# EasyEDA Pro project DartCharger.eprj, schematic DartCharger

## Sheets
1 Power: Create Date: 2024-04-09; Page Name: Power; Project Name: DartCharger; Schematic Name: DartCharger; Update Date: 2024-04-21; Company: 3SE战队; Drawed: 程浩; Page Size: A4; Version: V1.0
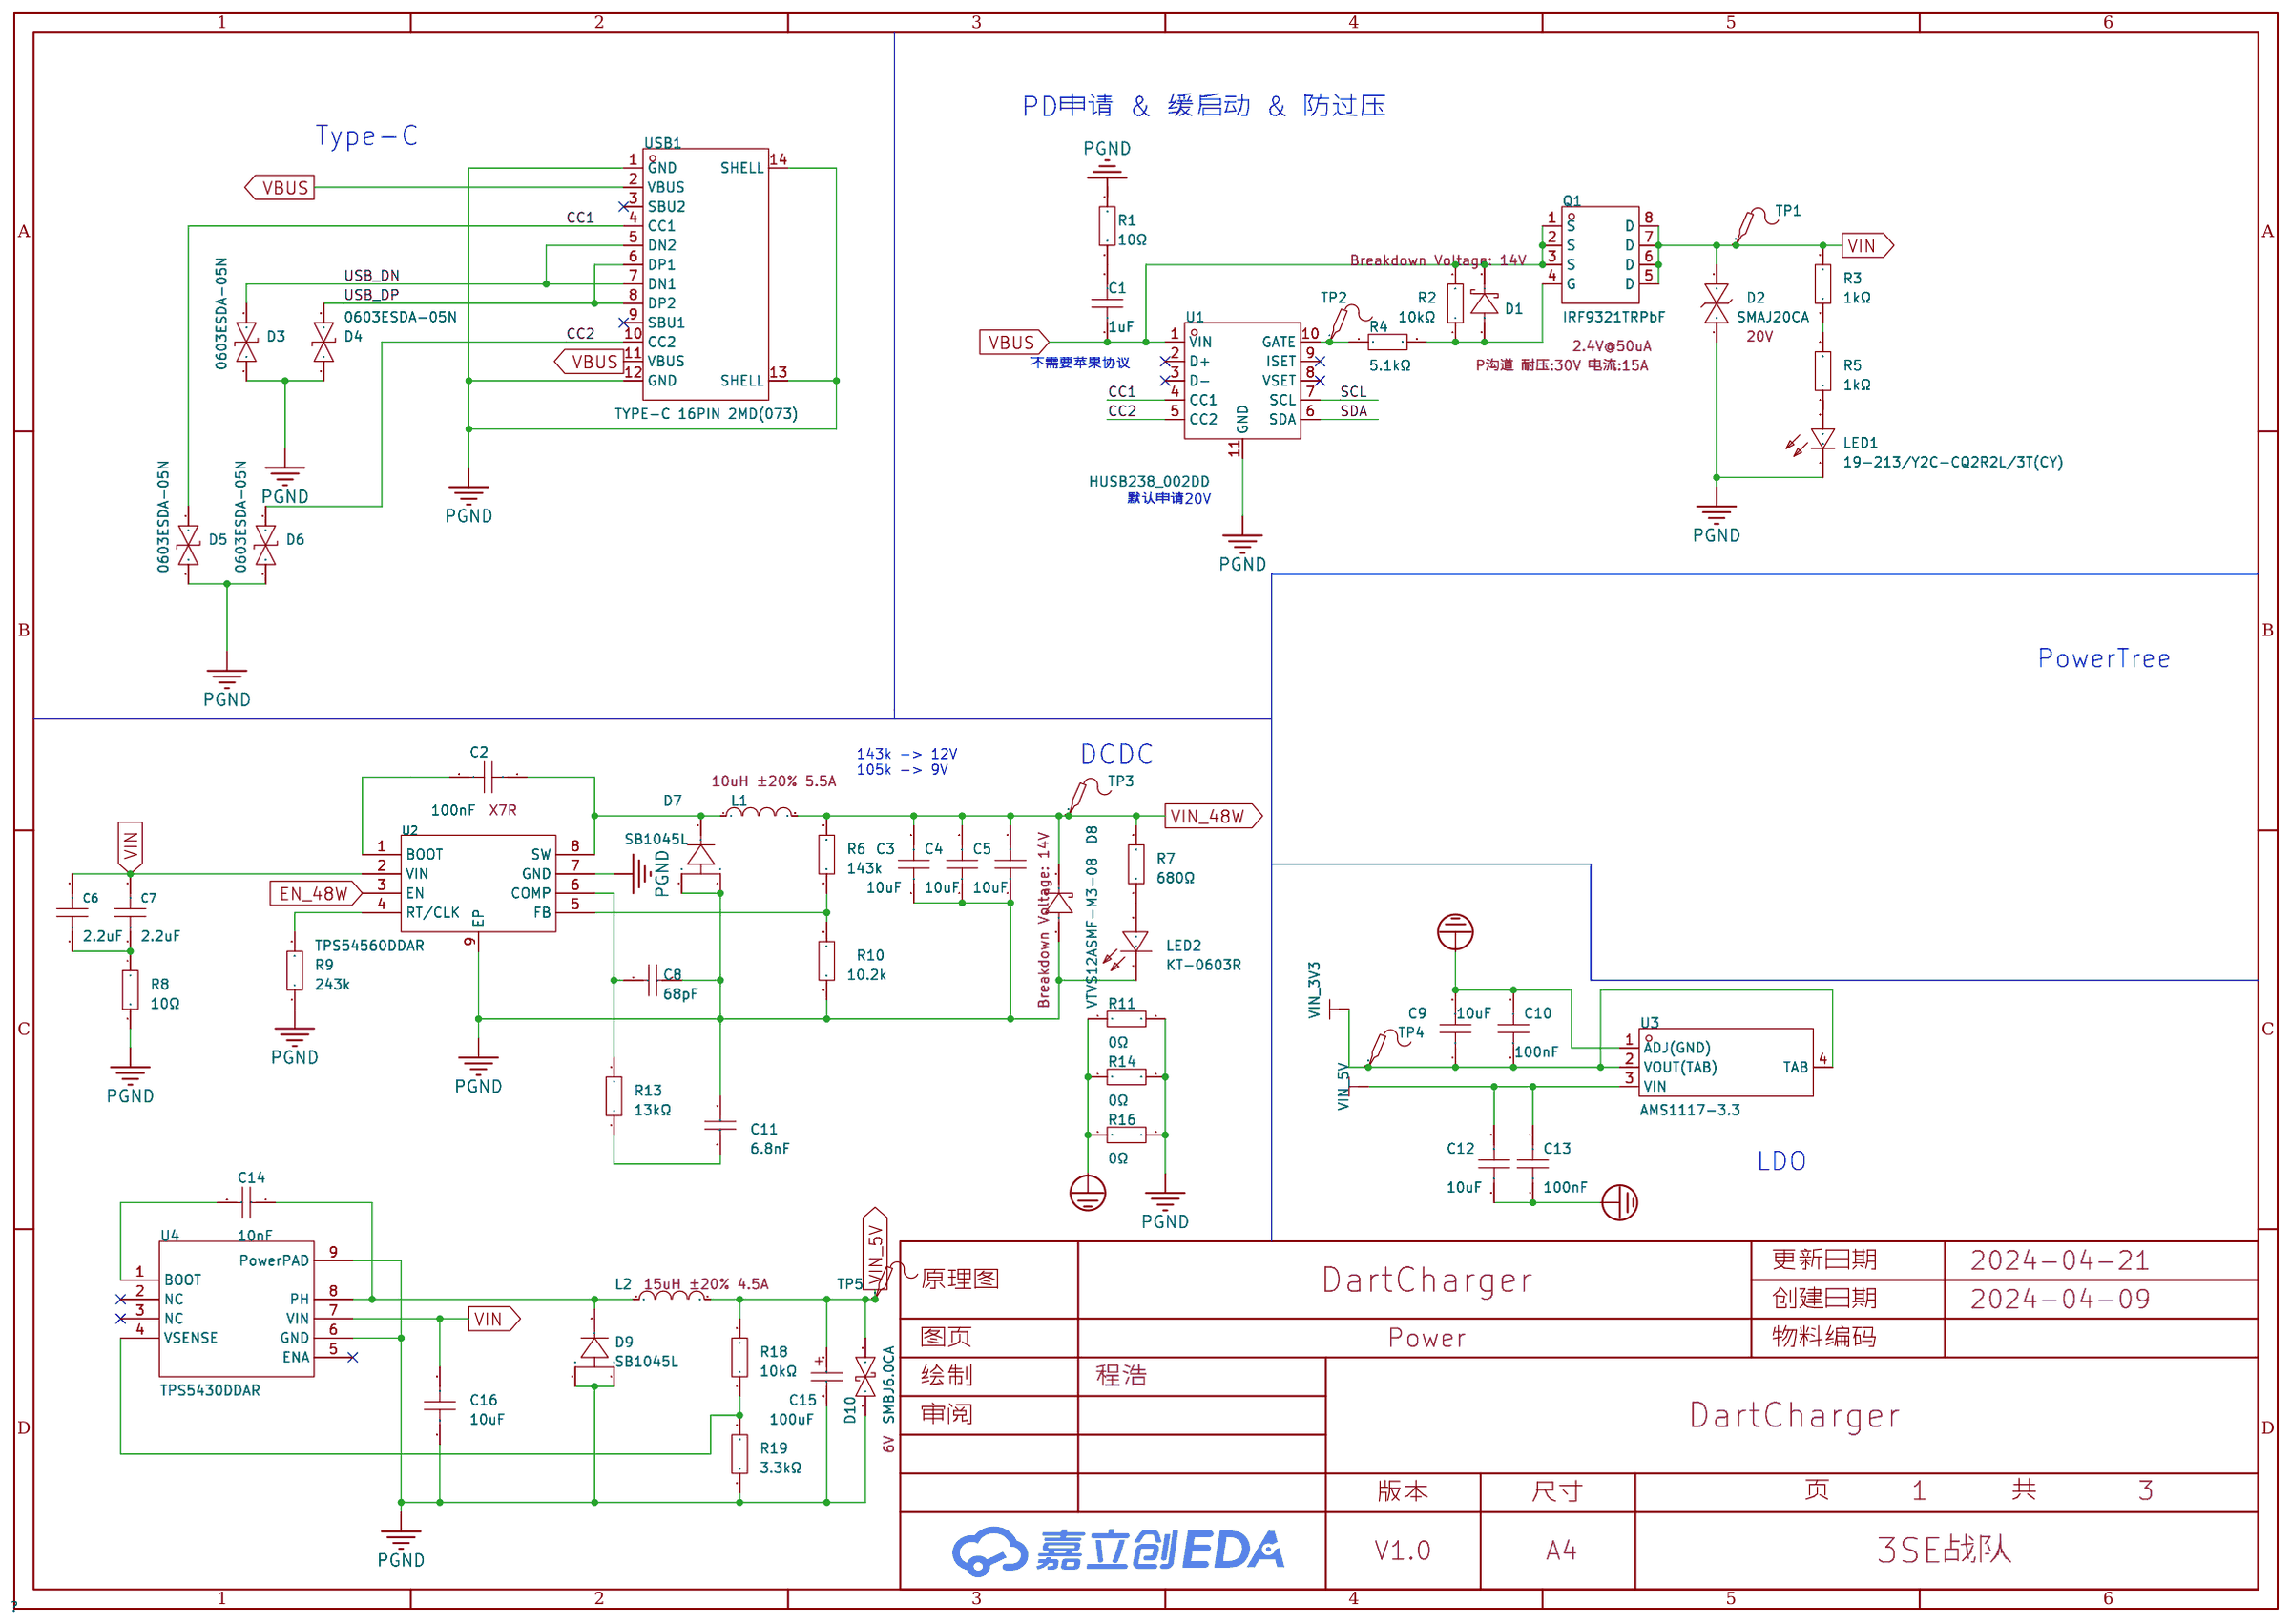
[diagram p0: Power]
2 MCU LCD: Create Date: 2024-04-15; Page Name: MCU LCD; Update Date: 2024-04-20; Company: 嘉立创EDA
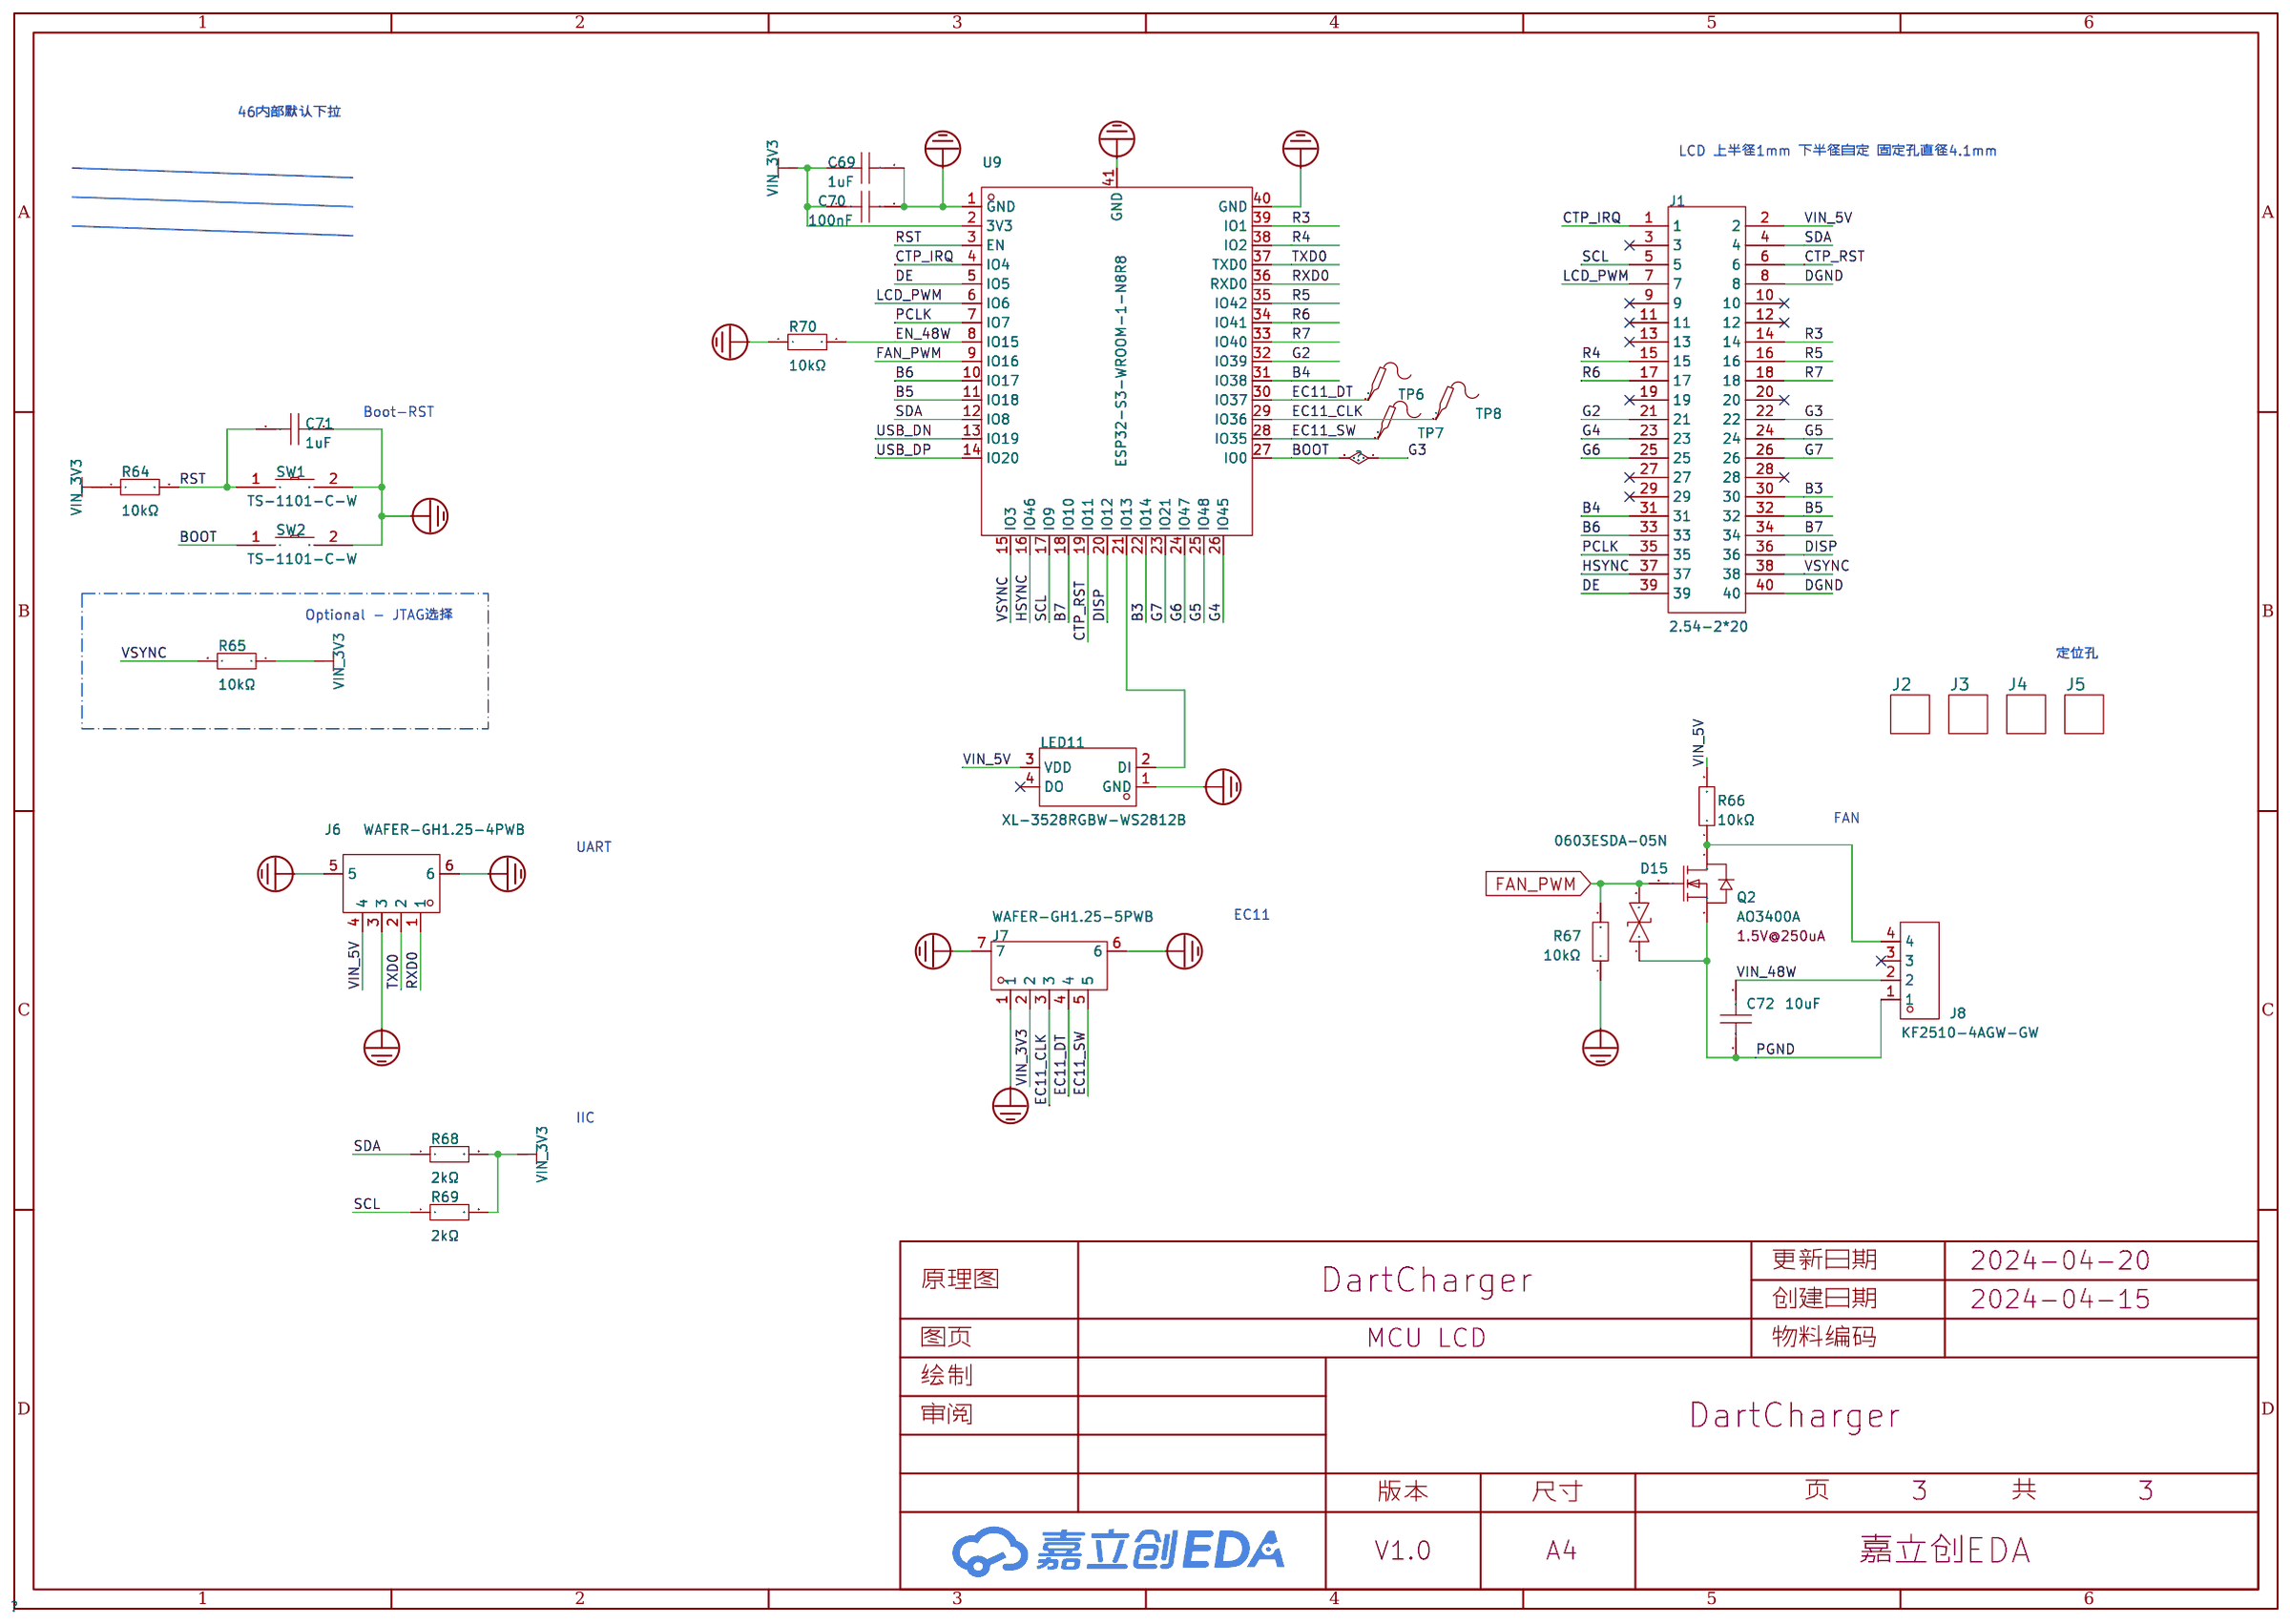
[diagram p1: MCU LCD]
3 Wireless TX: Create Date: 2024-04-16; Page Name: Wireless TX
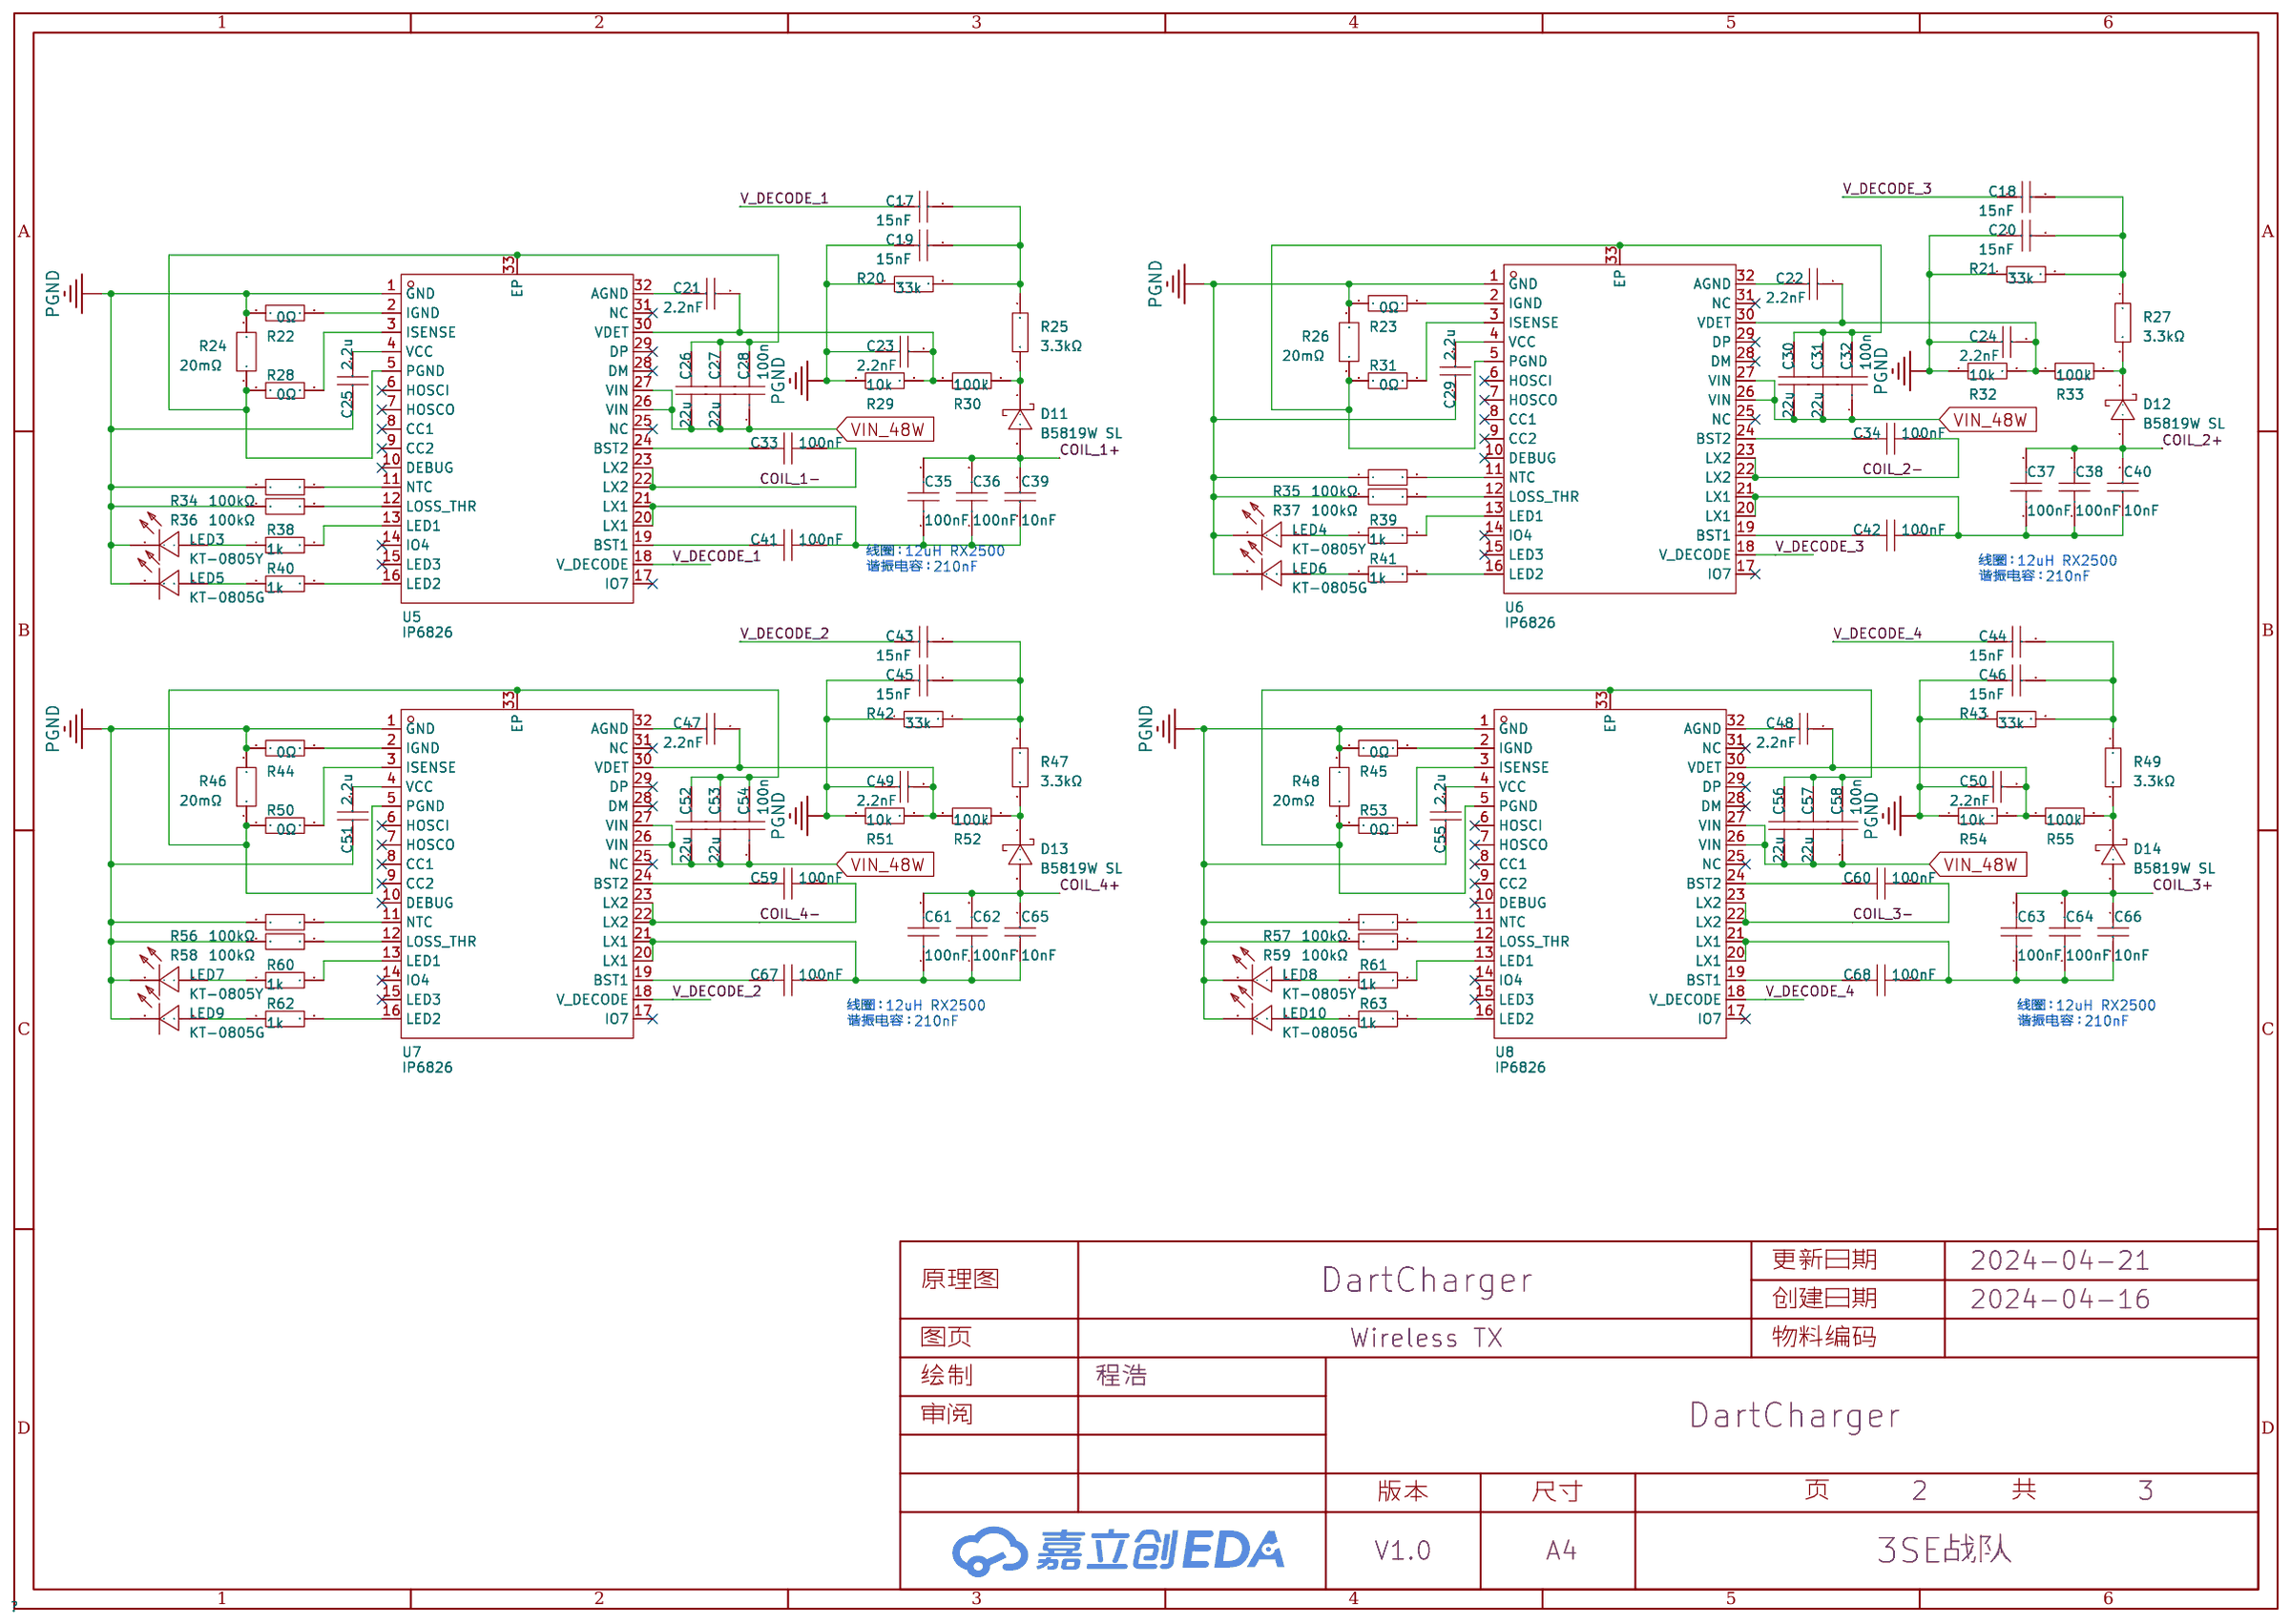
[diagram p2: Wireless TX]

## Parts
sheet MCU LCD
C69  1uF  [C0402]
C70  100nF  [C0402]
C71  1uF  [C0402]
C72  10uF  [C0805]
D15  0603ESDA-05N  [D0603-BI]
J1  2.54-2*20  [HDR-TH_40P-P2.54-V-F-R2-C20-S2.54]
J2  Hole-3mm-JK 孔  [HOLE-3MM]
J3  Hole-3mm-JK 孔  [HOLE-3MM]
J4  Hole-3mm-JK 孔  [HOLE-3MM]
J5  Hole-3mm-JK 孔  [HOLE-3MM]
J6  WAFER-GH1.25-4PWB  [CONN-SMD_4P-P1.25_XUNPU_WAFER-GH1.25-4PWB]
J7  WAFER-GH1.25-5PWB  [CONN-SMD_5P-P1.25_XUNPU_WAFER-GH1.25-5PWB]
J8  KF2510-4AGW-GW  [CONN-TH_4P-P2.54_CAX_KF2510-4AGW-GW]
LED11  XL-3528RGBW-WS2812B  [LED-SMD_4P-L3.5-W2.8-BR-1]
Q2  AO3400A  [SOT-23-3_L2.9-W1.6-P1.90-LS2.8-BR]
R64  10kΩ  [R0402]
R65  10kΩ  [R0603]
R66  10kΩ  [R0402]
R67  10kΩ  [R0402]
R68  2kΩ  [R0402]
R69  2kΩ  [R0402]
R70  10kΩ  [R0402]
SW1  TS-1101-C-W  [SW-SMD_L6.0-W3.3-LS8.0]
SW2  TS-1101-C-W  [SW-SMD_L6.0-W3.3-LS8.0]
TP6  -  [Test-Point-0.5mm]
TP7  -  [Test-Point-0.5mm]
TP8  -  [Test-Point-0.5mm]
U9  ESP32-S3-WROOM-1-N8R8  [WIRELM-SMD_ESP32-S3-WROOM-1]
sheet Power
C1  1uF  [C0402]
C2  100nF  [C0603]
C3  10uF  [C1206]
C4  10uF  [C1206]
C5  10uF  [C1206]
C6  2.2uF  [C0603]
C7  2.2uF  [C0603]
C8  68pF  [C0603]
C9  10uF  [C0603]
C10  100nF  [C0603]
C11  6.8nF  [C0603]
C12  10uF  [C0603]
C13  100nF  [C0603]
C14  10nF  [C0603]
C15  100uF  [CASE-B_3528]
C16  10uF  [C0603]
D1  VTVS12ASMF-M3-08  [SMF_L2.8-W1.8-LS3.7-FD-1]
D2  SMAJ20CA  [DO-214AC_L4.3-W2.7-LS5.0-BI]
D3  0603ESDA-05N  [D0603-BI]
D4  0603ESDA-05N  [D0603-BI]
D5  0603ESDA-05N  [D0603-BI]
D6  0603ESDA-05N  [D0603-BI]
D7  SB1045L  [TO-277_3P-L5.4-W4.0-LS6.5-TR]
D8  VTVS12ASMF-M3-08  [SMF_L2.8-W1.8-LS3.7-FD-1]
D9  SB1045L  [TO-277_3P-L5.4-W4.0-LS6.5-TR]
D10  SMBJ6.0CA  [SMB_L4.6-W3.6-LS5.3-BI]
L1  10uH  [IND-SMD_L7.3-W6.8]
L2  15uH  [IND-SMD_L7.0-W6.6_FXL0630]
LED1  19-213/Y2C-CQ2R2L/3T(CY)  [LED0603-RD-YELLOW]
LED2  KT-0603R  [LED0603-RD]
Q1  IRF9321TRPbF  [SOIC-8_L4.9-W3.9-P1.27-LS6.0-BL]
R1  10Ω  [R0402]
R2  10kΩ  [R0402]
R3  1kΩ  [R0603]
R4  5.1kΩ  [R0402]
R5  1kΩ  [R0603]
R6  143k  [R0603]
R7  680Ω  [R0805]
R8  10Ω  [R0603]
R9  243k  [R0603]
R10  10.2k  [R0603]
R11  0Ω  [R0603]
R13  13kΩ  [R0603]
R14  0Ω  [R0603]
R16  0Ω  [R0603]
R18  10kΩ  [R0402]
R19  3.3kΩ  [R0402]
TP1  -  [Test-Point-0.5mm]
TP2  -  [Test-Point-0.5mm]
TP3  -  [Test-Point-0.5mm]
TP4  -  [Test-Point-0.5mm]
TP5  -  [Test-Point-0.5mm]
U1  HUSB238_002DD  [DFN-10_L3.0-W3.0-P0.50-BL-EP2.5]
U2  TPS54560DDAR  [SOIC-8_L5.0-W4.0-P1.27-LS6.0-BL-EP2.0]
U3  AMS1117-3.3  [SOT-223-4_L6.5-W3.5-P2.30-LS7.0-BR]
U4  TPS5430DDAR  [ESOP-8_L4.9-W3.9-P1.27-LS6.0-TL-EP]
USB1  TYPE-C 16PIN 2MD(073)  [USB-C-SMD_TYPE-C-6PIN-2MD-073]
sheet Wireless TX
C17  15nF  [C0603]
C18  15nF  [C0603]
C19  15nF  [C0603]
C20  15nF  [C0603]
C21  2.2nF  [C0603]
C22  2.2nF  [C0603]
C23  2.2nF  [C0603]
C24  2.2nF  [C0603]
C25  2.2u  [C0603]
C26  22u  [C0805]
C27  22u  [C0805]
C28  100n  [C0603]
C29  2.2u  [C0603]
C30  22u  [C0805]
C31  22u  [C0805]
C32  100n  [C0603]
C33  100nF  [C0603]
C34  100nF  [C0603]
C35  100nF  [C0603]
C36  100nF  [C0603]
C37  100nF  [C0603]
C38  100nF  [C0603]
C39  10nF  [C0603]
C40  10nF  [C0603]
C41  100nF  [C0603]
C42  100nF  [C0603]
C43  15nF  [C0603]
C44  15nF  [C0603]
C45  15nF  [C0603]
C46  15nF  [C0603]
C47  2.2nF  [C0603]
C48  2.2nF  [C0603]
C49  2.2nF  [C0603]
C50  2.2nF  [C0603]
C51  2.2u  [C0603]
C52  22u  [C0805]
C53  22u  [C0805]
C54  100n  [C0603]
C55  2.2u  [C0603]
C56  22u  [C0805]
C57  22u  [C0805]
C58  100n  [C0603]
C59  100nF  [C0603]
C60  100nF  [C0603]
C61  100nF  [C0603]
C62  100nF  [C0603]
C63  100nF  [C0603]
C64  100nF  [C0603]
C65  10nF  [C0603]
C66  10nF  [C0603]
C67  100nF  [C0603]
C68  100nF  [C0603]
D11  B5819W SL  [SOD-123_L2.7-W1.6-LS3.7-RD-1]
D12  B5819W SL  [SOD-123_L2.7-W1.6-LS3.7-RD-1]
D13  B5819W SL  [SOD-123_L2.7-W1.6-LS3.7-RD-1]
D14  B5819W SL  [SOD-123_L2.7-W1.6-LS3.7-RD-1]
LED3  KT-0805Y  [LED0805-R-RD]
LED4  KT-0805Y  [LED0805-R-RD]
LED5  KT-0805G  [LED0805-R-RD]
LED6  KT-0805G  [LED0805-R-RD]
LED7  KT-0805Y  [LED0805-R-RD]
LED8  KT-0805Y  [LED0805-R-RD]
LED9  KT-0805G  [LED0805-R-RD]
LED10  KT-0805G  [LED0805-R-RD]
R20  33k  [R0402]
R21  33k  [R0402]
R22  0Ω  [R0603]
R23  0Ω  [R0603]
R24  20mΩ  [R0603]
R25  3.3kΩ  [R0402]
R26  20mΩ  [R0603]
R27  3.3kΩ  [R0402]
R28  0Ω  [R0603]
R29  10k  [R0402]
R30  100k  [R0402]
R31  0Ω  [R0603]
R32  10k  [R0402]
R33  100k  [R0402]
R34  100kΩ  [R0402]
R35  100kΩ  [R0402]
R36  100kΩ  [R0603]
R37  100kΩ  [R0603]
R38  1k  [R0402]
R39  1k  [R0402]
R40  1k  [R0402]
R41  1k  [R0402]
R42  33k  [R0402]
R43  33k  [R0402]
R44  0Ω  [R0603]
R45  0Ω  [R0603]
R46  20mΩ  [R0603]
R47  3.3kΩ  [R0402]
R48  20mΩ  [R0603]
R49  3.3kΩ  [R0402]
R50  0Ω  [R0603]
R51  10k  [R0402]
R52  100k  [R0402]
R53  0Ω  [R0603]
R54  10k  [R0402]
R55  100k  [R0402]
R56  100kΩ  [R0402]
R57  100kΩ  [R0402]
R58  100kΩ  [R0603]
R59  100kΩ  [R0603]
R60  1k  [R0402]
R61  1k  [R0402]
R62  1k  [R0402]
R63  1k  [R0402]
U5  IP6826  [QFN-32_L5.0-W5.0-P0.50-BL-EP3.8]
U6  IP6826  [QFN-32_L5.0-W5.0-P0.50-BL-EP3.8]
U7  IP6826  [QFN-32_L5.0-W5.0-P0.50-BL-EP3.8]
U8  IP6826  [QFN-32_L5.0-W5.0-P0.50-BL-EP3.8]

## Library data of the parts
C1 C69 C71 = CL05A105KA5NQNC: 容值:1uF;精度:±10%;额定电压:25V;材质(温度系数):X5R;; LCSC Part Name: 1uF ±10% 25V; Supplier Part: C52923; Manufacturer: SAMSUNG(三星); Supplier Footprint: 0402; JLCPCB Part Class: 基础库; Datasheet: https://atta.szlcsc.com/upload/public/pdf/source/20160218/1457707763339.pdf; Supplier: LCSC; Tolerance: ±10%; Voltage Rated: 25V; Temperature Coefficient: X5R
C70 = CC0402KRX7R7BB104: 容值:100nF;精度:±10%;额定电压:16V;材质(温度系数):X7R;; LCSC Part Name: 100nF ±10% 16V; Supplier Part: C60474; Manufacturer: YAGEO(国巨); Supplier Footprint: 0402; JLCPCB Part Class: 扩展库; Datasheet: https://atta.szlcsc.com/upload/public/pdf/source/20211223/9278FD768280B81DDBEF48FA36411A03.pdf; Supplier: LCSC; Tolerance: ±10%; Voltage Rated: 16V; Temperature Coefficient: X7R
C72 = GRM21BR61H106KE43L: 容值:10uF;精度:±10%;额定电压:50V;材质(温度系数):X5R;; LCSC Part Name: 10uF ±10% 50V; Supplier Part: C440198; Manufacturer: muRata(村田); Supplier Footprint: 0805; JLCPCB Part Class: 基础库; Datasheet: https://atta.szlcsc.com/upload/public/pdf/source/20230811/95AAE0C9AF55EDC31B7A4D8B733F534E.pdf; Supplier: LCSC; Tolerance: ±10%; Voltage Rated: 50V; Temperature Coefficient: X5R
D3-D6 D15 = 0603ESDA-05N: 极性:双向;反向截止电压(Vrwm):5V;最大钳位电压:50V;; LCSC Part Name: 双向ESD; Supplier Part: C316054; Manufacturer: BORN(伯恩半导体); Supplier Footprint: 0603; JLCPCB Part Class: 扩展库; Datasheet: https://atta.szlcsc.com/upload/public/pdf/source/20200528/C316054_1CC523E9CE69E41C8DD5A05C832CCD1A.pdf; Supplier: LCSC; polarity: 双向; Reverse Stand-Off Voltage (Vrwm): 5V; Maximum Clamping Voltage: 50V; Type: ESD
J1 = 2.54-2*20: 插孔结构:2x20P;间距:2.54mm;行距:2.54mm;圆孔/方孔:方孔;安装类型:直插;排数:双排;总孔位数:40P;额定电流:2.5A;额定电压:-;插孔方向:顶部;塑高:8.5mm;工作温度范围:-40℃~+105℃;; LCSC Part Name: 间距:2.54mm 2x20P 直插; Supplier Part: C2977589; Manufacturer: ZHOURI(洲日); Supplier Footprint: 插件,P=2.54mm; JLCPCB Part Class: 扩展库; Datasheet: https://atta.szlcsc.com/upload/public/pdf/source/20220328/834E302BE3C038BBC5C70F5E02589B1E.pdf; Supplier: LCSC; Holes Structure: 2x20P; Pitch: 2.54mm; Row Spacing: 2.54mm; Circular Hole / Square Hole: 方孔; Mounting Type: 直插; Number of Rows: 双排; Number of Holes: 40P; Current Rating (Max): 2.5A; Holes Direction: 顶部; Insulation Height: 8.5mm; Operating Temperature Range: -40℃~+105℃
J2-J5 = Hole-3mm-JK 孔: Manufacturer Part: Hole-3mm; Check: false
J6 = WAFER-GH1.25-4PWB: 插针结构:1x4P;间距:1.25mm;安装方式:卧贴;参考系列:GH;总PIN数:4P;排数:1;每排PIN数:4;额定电流:1A;工作温度范围:-25℃~+85℃;; LCSC Part Name: 1x4P 间距:1.25mm 卧贴 系列:GH; Supplier Part: C3029379; Manufacturer: XUNPU(讯普); Supplier Footprint: SMD,P=1.25mm,卧贴; JLCPCB Part Class: 扩展库; Datasheet: https://atta.szlcsc.com/upload/public/pdf/source/20220527/CB8773BFB0913C3B8ABD62CB38BA101A.pdf; Supplier: LCSC; Pins Structure: 1x4P; Pitch: 1.25mm; Mounting Style: 卧贴; Reference Series: GH; Number of Pins: 4P; Number of Rows: 1; Number of PINs Per Row: 4; Current Rating (Max): 1A; Operating Temperature Range: -25℃~+85℃
J7 = WAFER-GH1.25-5PWB: 插针结构:1x5P;间距:1.25mm;安装方式:卧贴;参考系列:GH;总PIN数:5P;排数:1;每排PIN数:5;额定电流:1A;工作温度范围:-25℃~+85℃;; LCSC Part Name: 1x5P 间距:1.25mm 卧贴 系列:GH; Supplier Part: C3029380; Manufacturer: XUNPU(讯普); Supplier Footprint: SMD,P=1.25mm,卧贴; JLCPCB Part Class: 扩展库; Datasheet: https://atta.szlcsc.com/upload/public/pdf/source/20220527/CB8773BFB0913C3B8ABD62CB38BA101A.pdf; Supplier: LCSC; Pins Structure: 1x5P; Pitch: 1.25mm; Mounting Style: 卧贴; Reference Series: GH; Number of Pins: 5P; Number of Rows: 1; Number of PINs Per Row: 5; Current Rating (Max): 1A; Operating Temperature Range: -25℃~+85℃
J8 = KF2510-4AGW-GW: 参考系列:-;间距:2.54mm;插针结构:1x4P;排数:1;每排PIN数:4;行距:-;公母:公型插针;安装方式:弯插;额定电流:3A;工作温度范围:-25℃~+85℃;; LCSC Part Name: 2.54mm 1x4P 弯插; Supplier Part: C722747; Manufacturer: CAX(创都); Supplier Footprint: 弯插,P=2.54mm; JLCPCB Part Class: 扩展库; Datasheet: https://atta.szlcsc.com/upload/public/pdf/source/20200903/C722719_349FB032BA69A16250788D6DAC1BEE3A.pdf; Supplier: LCSC; Pitch: 2.54mm; Pins Structure: 1x4P; Number of Rows: 1; Number of PINs Per Row: 4; Gender: 公型插针; Mounting Style: 弯插; Current Rating (Max): 3A; Operating Temperature Range: -25℃~+85℃
LED11 = XL-3528RGBW-WS2812B: 发光颜色:RGB三色;二极管配置:-;功率:50mW；50mW；45mW;主波长:618nm~623nm；520nm~525nm；467nm~472nm;发光角度:120°;安装方式:正贴;工作温度:-25℃~+80℃;; LCSC Part Name: RGB三色 正贴 幻彩; Supplier Part: C2890364; Manufacturer: XINGLIGHT(成兴光); Supplier Footprint: SMD3528-4P; JLCPCB Part Class: 扩展库; Datasheet: https://atta.szlcsc.com/upload/public/pdf/source/20230707/D057C4FFF40CAC379BBCAAC4763A2431.pdf; Supplier: LCSC; Emitted Color: RGB三色; Power Dissipation: 50mW；50mW；45mW; Forward Current: 20mA; Dominant Wavelength: 618nm~623nm；520nm~525nm；467nm~472nm; Peak Wavelength: 525nm；623nm；472nm; Viewing Angle: 120°; Mounting Sytle: 正贴; Operating Temperature: -25℃~+80℃
Q2 = AO3400A_C20917: 类型:1个N沟道;漏源电压(Vdss):30V;连续漏极电流(Id):5.7A;功率(Pd):1.4W;导通电阻(RDS(on)@Vgs,Id):26.5mΩ@10V,5.7A;阈值电压(Vgs(th)@Id):1.5V@250uA;; LCSC Part Name: 1个N沟道 耐压:30V 电流:5.7A; Supplier Part: C20917; Manufacturer: AOS; Supplier Footprint: SOT-23-3L; JLCPCB Part Class: 基础库; Datasheet: https://atta.szlcsc.com/upload/public/pdf/source/20140107/1457706668533.pdf; Supplier: LCSC; Type: 1个N沟道; Drain Source Voltage (Vdss): 30V; Continuous Drain Current (Id): 5.7A; Power Dissipation (Pd): 1.4W; Drain Source On Resistance (RDS(on)@Vgs,Id): 26.5mΩ@10V,5.7A; Gate Threshold Voltage (Vgs(th)@Id): 1.5V@250uA; Total Gate Charge (Qg@Vgs): 7nC@4.5V; Input Capacitance (Ciss@Vds): 630pF@15V; Operating Temperature: -55℃~+150℃@(Tj)